# EasyEDA Pro project ProPrj_Starcat_FOC双路矢量控制器_2024-11-11.epro, board 双路大功率矢量控制器_2 (continued)
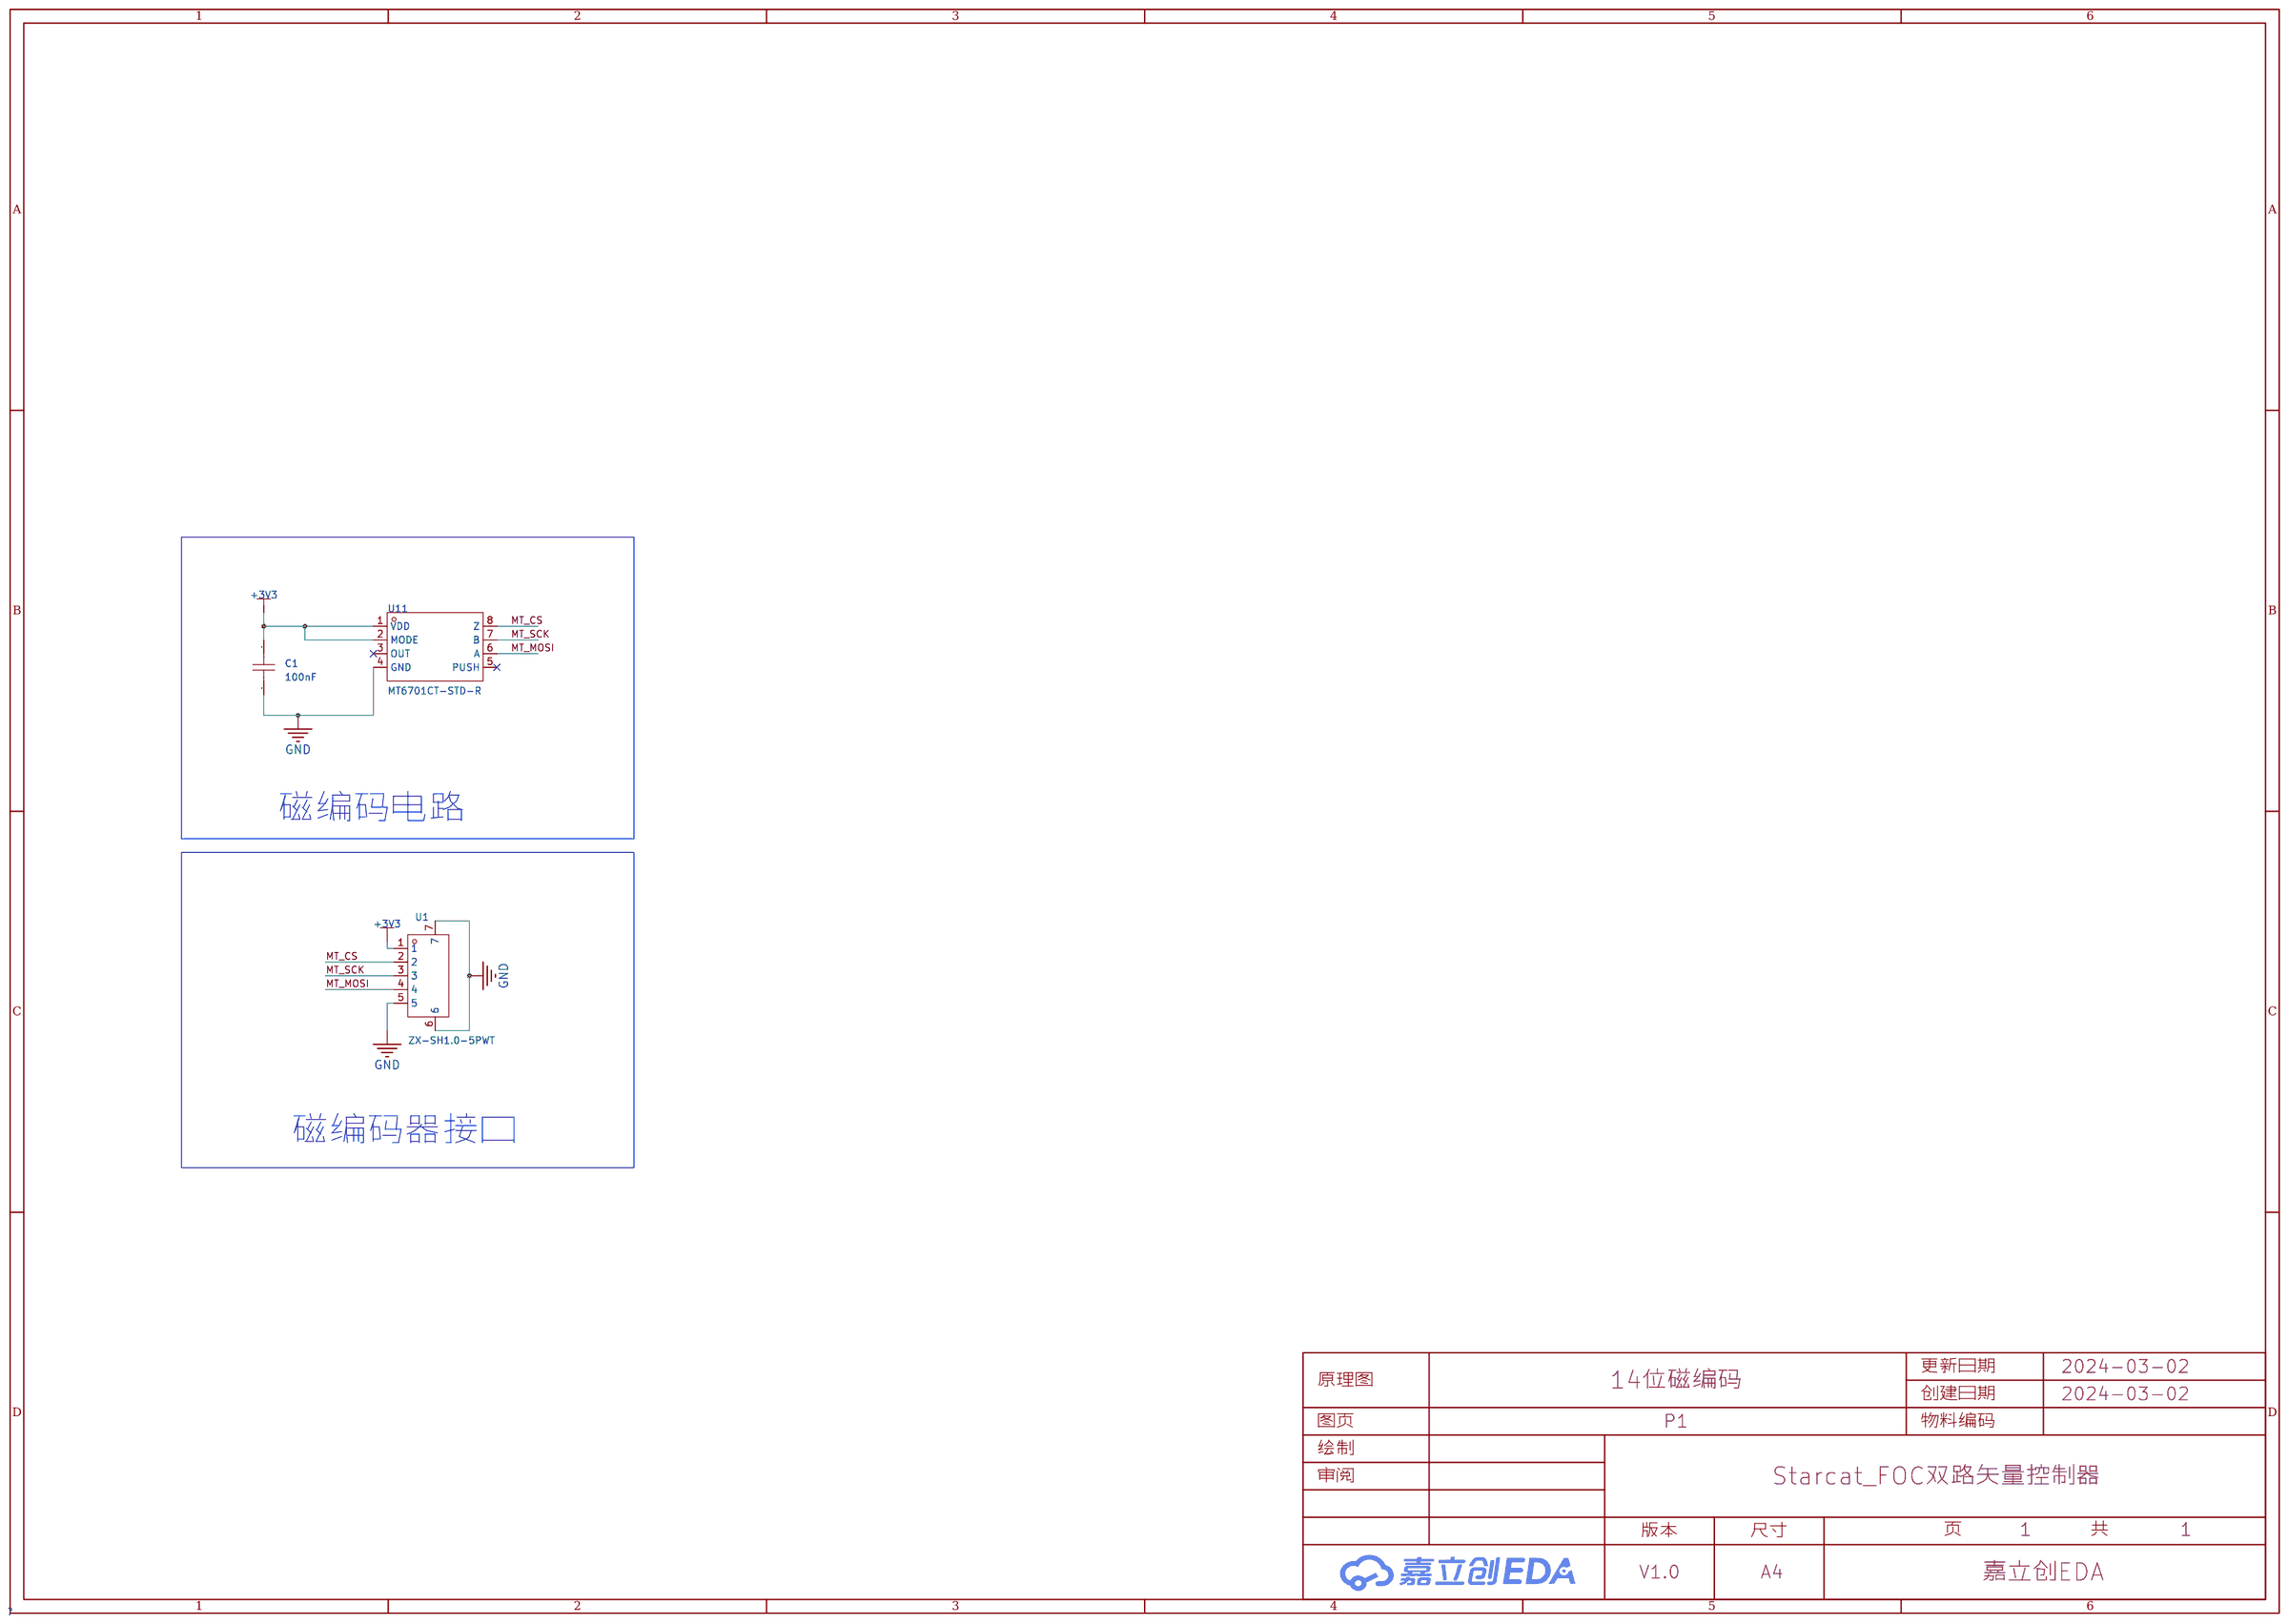
[diagram p0: schematic sheet]
## Routing (per net, layer and track width the routed paths; a pad name or vN(x,y) marks a point on that pad's centre or on a via; arc(x,y) is an arc through that point) (continued)
  Bottom Layer w0.635: 61.95,28.7 63.12,28.7
  vias: v1(10.22,1.47) v1(10.75,48.1) v1(69.13,41.16)
+3V3_VDA: length 6.1
  Top Layer w0.305: 29.28,33.37 30.54,33.37 C5.1 31.78,34.6 31.78,36.07 31.88,36.17 33.34,36.17 33.36,36.15
+3V3A: length 122.2
  Top Layer w0.305: v1(11.68,39.86) 12.83,39.86 13.11,40.14 U18.24 ; v1(54.93,25.82) 54.91,25.8 54.19,25.8 49.2,20.82 ; 34.28,20.81 29.32,25.77 29.3,25.77 ; v1(30.94,29.18) 30.94,29.33 28.92,31.35 26.61,31.35 26.35,31.61 v1(26.35,33.15) 26.35,33.23 26.48,33.37 C3.1 ; U17.24 55.47,40.08 v1(53.34,37.95)
  Top Layer w0.508: 27.86,33.34 27.9,33.38 27.83,33.45 26.65,33.45 26.63,33.47 ; v1(53.34,37.95) 53.26,38.03 v1(48.63,38.03)
  Inner2 w0.305: v1(53.34,37.95) 54.38,36.91 v1(56.55,36.91)
  Inner2 w0.508: 26.35,33.17 26.35,33.12 26.38,33.09 41.27,33.09 43.83,35.65 46.57,35.65 48.63,37.71 v1(48.63,38.03)
  Bottom Layer w0.305: v1(29.19,25.81) 29.19,27.43 v1(30.94,29.18) ; v1(56.55,36.91) 57.04,36.42 57.04,30.08 54.93,27.97 v1(54.93,25.82) ; v1(53.34,37.95) 53.21,37.82
  Bottom Layer w0.508: v1(11.68,39.86) 12.45,40.62 22.86,40.62 23.62,39.86 23.62,33.89 24.36,33.15 v1(26.35,33.15) 26.35,35.85 30.27,39.77 TP3.1 ; v1(53.34,37.95) 53.34,40.75 51.25,42.84 U2.5 50.07,44.91 49.78,45.19 49.78,46.62 C8.2
+5V:
  vias: v1(37.59,1.76)
+9V: length 20
  Bottom Layer w0.305: 70.06,43.2 70.03,43.2 70.02,43.19
  Bottom Layer w0.381: U12.2 73.53,39.16 74.22,39.85 74.22,42.86 73.88,43.2 70.06,43.2
  Bottom Layer w0.508: 68.9,46.54 69.66,46.54 69.92,46.28 69.92,44.57 70.32,44.18 70.96,44.18 71.01,44.23 ; 70.06,44.14 70.06,43.2
AGND: length 537.6
  Top Layer w0.305: 49.77,48.23 49.62,48.08 49.62,43.45 49.91,43.16 52.2,43.16 ; U16.63 35.86,45.48 35.56,45.79 33.5,45.79 C13.2 ; R25.1 43.51,26.71 C45.1 v1(41.6,26.71) C98.1 ; 25.58,35.49 25.15,35.92 24.38,35.92 24.11,35.64 U18.55 ; 25.58,35.49 25.58,36.62 v1(25.57,36.63) ; 25.58,35.49 26.24,34.83 C3.2 27.83,34.83 L4.1 ; 13.43,45.68 13.02,45.27 10.42,45.27 10,45.69 ; C82.1 52.01,45.89 51.69,45.57 51.69,43.67 52.2,43.16 ; 30.63,36.21 30.05,35.63 28.48,35.63 27.94,35.09 ; 52.2,43.16 53.21,43.16 53.47,42.9 53.47,41.59 U17.28 ; U16.18 35.86,30.76 33.93,28.82 33.93,27.41 34.63,26.71 v1(35.9,26.71) 37.16,26.71 R26.1 ; v1(7.37,26.27) 7.81,26.71 C88.2 ; v1(24.53,35.94) 23.59,36.88 v1(19.82,36.88)
  Top Layer w0.508: 70.06,1.7 71,1.7 71.03,1.74 ; 70.06,1.7 70.06,2.14 ; 70.06,1.7 70.06,2.14 ; 70.06,1.7 70.06,0.95 69.72,0.61 67.24,0.61 v1(67.2,0.66) 66.01,0.66 U13.7 ; 70.06,2.14 70.06,4.84 ; 71.88,45.84 72.65,45.84 72.74,45.93 ; 13.69,45.73 13.73,45.77 13.73,46.97 ; 69.19,45.89 68.37,45.89 68.11,46.15 68.11,46.66 67.67,47.1 66.16,47.1 65.81,46.75 65.81,46 ; 19.69,45.93 19.93,46.16 19.93,47.39 ; 47.79,45.78 47.79,47.64 48.37,48.23 49.77,48.23 v1(49.79,48.25) ; 74.34,20 72.79,20 v1(72.77,20.02) ; U10.5 14.83,5.08 15.24,4.68 15.24,2.58 U10.6 ; 73.37,27.18 74.06,27.88 74.06,31.02 73.32,31.76 70.94,31.76 ; 73.06,46 73.56,46 74.17,45.4 74.17,42.82 73.66,42.31 73.1,42.31 ; 30.57,42.76 30.63,42.82 30.63,45.23 30.14,45.72 22.66,45.72 ; 9.88,45.8 9.79,45.89 9.79,46.94 ; C82.1 52.32,46.15 C84.1 ; 72.95,41.32 73,41.37 74.23,41.37 74.65,40.95 74.65,39.39 ; 8.87,47.11 8.87,45.99 8.86,45.98 ; 56.12,47.1 56.16,47.07 56.16,45.93 ; 72.79,26.68 70.66,26.68 ; 72.79,26.68 72.79,22.55 ; 72.79,26.68 73.09,26.68 73.22,26.81 ; 9.96,47.11 9.95,47.12 8.79,47.12 ; 56.32,47.3 57.54,47.3 57.88,46.96 60.86,46.96 61.26,46.55 61.26,46.28 ; C11.2 C14.1 44.7,45.7 44.7,47.22 45.34,47.86 47.12,47.86 47.75,47.22 C17.1 ; 8.23,0.73 14.26,0.73 ; v1(58.08,48.35) 63.76,48.35 64.39,47.73 v1(64.39,46.76) 64.5,46.76 65.48,45.78
  Top Layer w0.635: 7.94,34.78 9.15,34.78 v1(9.16,34.77) ; v1(72.89,41.34) 72.55,41.34 C65.1 ; v1(7.24,48.11) 8.51,48.11 8.83,47.79 8.83,47.12 8.87,47.09 ; 10.91,41.25 10.32,41.25 v1(10.31,41.24) 10.27,41.2 7.99,41.2
  Top Layer w0.762: 45.8,32.41 45.78,32.39 44.64,32.39 ; 47.53,26.65 47.53,26.48 46.97,25.92 43.93,25.92 43.45,26.4
  Inner1 w0.305: v1(34.82,45.76) 34.79,45.79 31.04,45.79 30.61,45.36 v1(30.61,42.65) 25.97,42.65 25.6,42.28 25.6,36.23 26.1,35.73 30.1,35.73 v1(30.6,36.23)
  Inner1 w0.508: v1(76.3,29.31) 76.25,29.31 72.77,25.83 v1(72.77,22.51) ; v1(30.61,42.65) 28.84,40.88 16.1,40.88 14.56,42.42 13.84,42.42 13.75,42.51 13.75,47.87 14.29,48.41 19.69,48.41 19.92,48.18 v1(19.92,47.42) ; v1(49.79,48.25) 49.89,48.35 v1(58.08,48.35) 62.75,48.35 63.25,47.86 v1(63.25,46.84)
  Inner1 w0.635: v1(2.21,24.91) 2.15,24.97 v1(1.42,24.97) 1.2,25.2 v1(1.2,35.27) ; 9.69,41.24 9.54,41.24 8.83,41.95 v1(8.83,47.23) ; 9.69,41.24 6.95,38.5 v1(3.43,38.5) ; 9.69,41.24 v1(10.31,41.24) 10.42,41.13 13.71,41.13 15.75,39.09 v1(15.88,39.09) ; v1(64.39,46.76) 64.5,46.87 72.11,46.87 v1(73,45.98) ; v1(9.16,34.77) 9.16,32.59 9.01,32.44 1.8,32.44 1.48,32.13
  Inner2 w0.508: v1(12.11,0.62) 40.01,0.62 v1(40.13,0.74) 40.22,0.66 v1(67.2,0.66) 70.8,0.66 71.25,1.1 71.25,16.23 70.99,16.49
  Inner2 w0.635: v1(74.34,8.48) 72.63,10.19 72.63,15.33 v1(72.59,15.37)
  Bottom Layer w0.305: LED3.2 2.03,25.25 ; v1(7.37,26.27) 7.37,25.25 ; 65.5,27.15 65.39,27.26 62.07,27.26 ; 18.5,46.69 17.77,46.69 17.06,45.98 15.91,45.98 15.4,45.47 15.4,44.66 15.59,44.47 16.24,44.47 16.61,44.11 16.61,41.44 16.44,41.27 10.34,41.27 v1(10.31,41.24) ; 64.35,27.1 64.35,24.97 64.34,24.96 ; 76.3,29.37 v1(76.3,29.31) 76.3,29.16 76.18,29.05 73.85,29.05 73.85,28.68 72.35,27.18 69.07,27.18 ; 41.66,25.25 41.66,26.65 v1(41.6,26.71) ; v1(35.9,26.71) 35.94,26.66 35.94,25.25
  Bottom Layer w0.381: U12.12 73.37,32.16 73.85,31.68 73.85,29.05 ; U12.7 76.2,35.66 76.34,35.79 ; U12.5 74.05,37.06 74.42,36.68 76.31,36.68 76.34,36.65
  Bottom Layer w0.508: 64.45,46.69 64.37,46.77 62.16,46.77 ; v1(52.32,46.08) 52.32,47.38 U2.2 ; v1(7.24,48.11) 7.24,47.91 6.04,46.72 5.64,46.72 ; v1(25.57,36.63) 25.79,36.84 TP1.1 ; 37.64,48.34 37.67,48.31 37.67,47.74 37.32,47.39 35.66,47.39 34.82,46.55 v1(34.82,45.76) 34.82,43.78 ; v1(58.08,48.35) 57.42,48.35 57.24,48.17 54.99,48.17 ; v1(47.53,26.69) 48.99,28.15 50.42,28.15 50.93,28.66 50.93,29.89 50.35,30.46 48.04,30.46 46.04,32.46 44.77,32.46 v1(44.64,32.59) ; 59.78,47.3 59.78,46.47 60.02,46.22 61.47,46.22 62.08,46.82 ; 71.17,46.66 72.32,46.66 v1(73,45.98) 73.5,45.98 75.1,44.39 ; 68.73,44.06 68.56,43.89 68.56,42.42 69.02,41.95 71.47,41.95 72.08,41.34 v1(72.89,41.34) ; v1(61.41,37.05) 61.41,30.26 59,27.85 59,27.2 59.51,26.7 60.17,26.7 60.67,26.19 61.73,26.19 61.96,26.43 61.96,27.17 ; v1(63.25,46.84) 63.25,46.8 C2.1
  Bottom Layer w0.635: 1.96,38.42 2.02,38.48 5.14,38.48 ; SW2.2 73.03,15.37 v1(72.59,15.37) 72.5,15.28 L1.1 ; 76.27,29.34 76.3,29.37 76.34,29.41 76.34,43.06 75.19,44.2 ; 74.94,22.81 73.07,22.81 v1(72.77,22.51) 72.77,19.98 72.65,19.86 ; 1.89,40.26 1.89,35.47 ; 72.65,19.86 70.49,19.86 ; 72.65,19.86 74.13,19.86
  vias: v1(2,35.3) v1(15.9,38.32) v1(15.9,37.62) v1(15.9,36.88) v1(16.66,39.09) v1(16.68,38.32) v1(16.68,37.62) v1(16.68,36.88) v1(17.44,39.09) v1(17.47,38.32) v1(17.47,37.62) v1(17.47,36.88) v1(18.23,39.09) v1(18.25,38.32) v1(18.25,37.62) v1(18.25,36.88) v1(19.01,39.09) v1(19.03,38.32) v1(19.03,37.62) v1(19.03,36.88) v1(19.79,39.09) v1(19.82,38.32) v1(19.82,37.62) v1(25.26,35.84) v1(37.63,48.36) v1(40.13,1.88) v1(58.3,38.97) v1(58.28,38.32) v1(58.28,37.68) v1(58.28,37.05) v1(59.08,38.97) v1(59.06,38.32) v1(59.06,37.68) v1(59.06,37.05) v1(59.84,38.32) v1(59.84,37.68) v1(59.84,37.05) v1(59.86,38.97) v1(60.65,38.97) v1(60.63,38.32) v1(60.63,37.68) v1(60.63,37.05) v1(61.3,46.12) v1(61.43,38.97) v1(61.41,38.32) v1(61.41,37.68) v1(62.21,38.97) v1(62.19,38.32) v1(62.19,37.68) v1(62.19,37.05) v1(68.02,0.64) v1(70.05,1.7) v1(70.99,16.49) v1(72.19,41.33) v1(74.34,14.15) v1(74.66,39.17)
GND_VDA: length 5.6
  Top Layer w0.305: 33.36,36.65 31.72,36.65 31.37,36.3 31.37,35.16 31.04,34.83 C5.2 30.6,34.83 L4.2
PGND: length 96.1
  Top Layer w0.381: 54.74,35.79 60.71,35.79 60.97,35.53 U17.44 ; 54.74,35.79 54.1,35.79 53.97,35.67 53.97,34.17 U17.30 ; 54.74,35.79 54.97,35.56 U17.32 ; 12.95,35.92 11.94,35.92 11.61,35.59 U18.30 11.6,34.28 11.6,30.37 v1(10.8,29.57) ; 12.95,35.92 18.16,35.92 18.61,35.47 U18.44 ; 12.95,35.92 12.61,35.57 U18.32
  Top Layer w0.508: 52.45,26.72 52.45,26.06 v1(52.26,25.86)
  Inner1 w0.508: v1(49.17,26.7) 50.09,25.78 52.18,25.78 v1(52.26,25.86)
  Inner2 w0.305: v1(10.92,26.65) 10.92,29.44 v1(10.8,29.57)
  Inner2 w0.508: v1(14.22,26.64) 14.13,26.64 11.23,23.74 11.23,22.08 10.7,21.55 10.7,13.3 v1(10.76,13.3) ; v1(49.17,26.7) 46.98,24.52 43.08,24.52 40.82,22.25 v1(40.82,12.7) ; v1(10.92,26.65) 10.67,26.4 10.67,22.41 10.17,21.91 v1(10.17,12.71)
  Bottom Layer w0.305: v1(10.92,26.65) 10.89,26.62 10.86,26.62
  Bottom Layer w0.508: v1(52.26,25.86) 52.55,26.15 52.55,29.44 55.49,32.38 v1(55.49,35.84)
  vias: v1(7.2,10.97) v1(29.32,13.97) v1(29.36,12.88) v1(29.42,11.61) v1(29.63,12.29) v1(29.68,13.43) v1(29.76,11.01) v1(29.98,13.98) v1(30.05,12.88) v1(30.09,11.62) v1(30.32,13.44) v1(30.26,12.3) v1(30.45,10.97) v1(30.61,13.98) v1(30.71,12.86) v1(30.74,11.59) v1(30.89,12.24) v1(30.96,13.44) v1(31.16,11) v1(31.26,14) v1(31.33,12.85) v1(31.42,11.58) v1(31.54,12.23) v1(31.57,13.46) v1(40.82,11.88) v1(56.33,35.86) v1(60.48,13.97) v1(60.52,12.88) v1(60.57,11.6) v1(60.83,13.43) v1(60.79,12.28) v1(60.91,11.01) v1(61.14,13.98) v1(61.21,12.88) v1(61.24,11.62) v1(61.42,12.29) v1(61.48,13.44) v1(61.6,10.97) v1(61.77,13.98) v1(61.86,12.86) v1(61.9,11.59) v1(62.05,12.24) v1(62.12,13.44) v1(62.32,11) v1(62.41,13.99) v1(62.48,12.84) v1(62.58,11.58) v1(62.73,13.45) v1(62.69,12.22)
VBUS_5V: length 22.7
  Top Layer w0.635: 7.83,40.42 10.23,40.42 v1(10.8,39.86) ; v1(10.8,35.92) 10.49,35.61 7.86,35.61
  Bottom Layer w0.635: v1(10.8,39.86) v1(10.8,35.92) 10.8,32.74 10.32,32.26 6.09,32.26 5.1,31.28 5.1,30.64 ; 4.89,30.81 3.45,30.81 2.78,31.48
AH_1: length 18.2
  Top Layer w0.305: v1(58.8,43.28) 58.97,43.11 U17.17 ; v1(52.45,38.97) 52.14,38.65 U16.41
  Inner1 w0.305: v1(52.45,38.97) 55.44,38.97 58.8,42.33 v1(58.8,43.28)
AH_2: length 36.7
  Top Layer w0.305: U16.37 40.25,36.65 v1(39.91,36.99) ; v1(16.05,45.13) 16.05,44.81 16.61,44.25 U18.17
  Inner2 w0.305: v1(39.91,36.99) 39.91,37.03 32.42,44.53 18.53,44.53 17.24,45.82 16.55,45.82 16.05,45.31 v1(16.05,45.13)
AL_1: length 17.1
  Top Layer w0.305: U17.18 58.47,40.16 58.17,39.86 57.02,39.86 53.72,36.55 52.07,36.55 50.67,35.15 U16.34
AL_2: length 40.6
  Top Layer w0.305: U18.18 16.11,43.6 v1(15.99,43.71) ; U16.23 38.36,34.39 v1(38.35,34.39)
  Inner2 w0.305: v1(15.99,43.71) 15.99,40.99 15.49,40.49 13.33,40.49 12.83,39.98 12.83,35.54 14.08,34.28 38.24,34.28 v1(38.35,34.39)
AO_1: length 20.9
  Top Layer w0.305: U17.46 61.97,31.73 64.13,29.57 65.58,29.57 66.42,28.73 66.42,27.85 66.76,27.51 68.14,27.51 68.81,26.84 68.81,26.72
  Top Layer w0.508: C66.2 68.97,17.76
AO_2: length 28.7
  Top Layer w0.305: v1(26.92,29.44) 26.42,29.95 24.02,29.95 22.25,31.73 19.94,31.73 19.61,32.06 U18.46
  Top Layer w0.508: v1(30.73,26.78) 31.03,26.78 38.1,19.7 38.1,17.76
  Inner2 w0.305: v1(26.92,29.44) 29.6,29.44 30.73,28.31 v1(30.73,26.78)
BH_1: length 16.9
  Top Layer w0.305: U16.42 51.62,39.15 v1(52.2,39.73) ; U17.19 57.97,43.09 v1(58.04,43.16)
  Inner1 w0.305: v1(58.04,43.16) 58.04,42.35 55.42,39.73 v1(52.2,39.73)
BH_2: length 37.6
  Top Layer w0.305: U18.19 15.61,43.08 v1(15.3,43.39) ; v1(40.64,37.32) 40.64,37.18 40.68,37.15 U16.38
  Inner2 w0.305: v1(15.3,43.39) 15.26,43.43 15.26,45.21 16.44,46.39 17.59,46.39 19.02,44.96 32.8,44.96 40.44,37.32 v1(40.64,37.32)
BL_1: length 15.7
  Top Layer w0.305: U16.35 50.53,35.65 51.94,37.06 53.47,37.06 56.77,40.36 57.27,40.36 57.47,40.57 U17.20
BL_2: length 40.9
  Top Layer w0.305: v1(14.57,43.16) 15.11,42.62 U18.20 ; v1(39.5,34.22) 39.86,33.86 U16.26
  Inner2 w0.305: v1(39.5,34.22) 39.06,33.78 13.69,33.78 12.32,35.16 12.32,40.36 13.08,41.13 14.1,41.13 14.57,41.6 v1(14.57,43.16)
BO_1: length 20.1
  Top Layer w0.305: U17.41 59.47,30.93 61.55,28.85 61.55,27.68 61.76,27.47 63.09,27.47 63.74,26.83
  Top Layer w0.508: C69.2 64.02,23.35 60.07,19.41 60.07,18.14
BO_2: length 24
  Top Layer w0.305: U18.41 17.11,31.89 19.13,29.87 21.41,29.87 v1(22.1,29.19)
  Top Layer w0.508: 28.96,17.25 28.96,19.79 25.78,22.97 v1(25.78,26.78)
  Inner2 w0.305: v1(25.78,26.78) 24.51,26.78 v1(22.1,29.19)
CAN_H: length 37.3
  Top Layer w0.305: v1(14.86,47.35) 15.12,47.08 15.12,47.03
  Inner1 w0.305: 27.02,43.44 27.01,43.45 27.01,44.69 26.72,44.98 17.92,44.98 17,45.9 16.3,45.9 v1(14.86,47.35)
  Bottom Layer w0.305: v1(14.86,47.35) 14.22,46.71 U19.7 ; 45.59,43.61 45.59,42.91 45.29,42.6 42.5,42.6 41.61,41.71 34.46,41.71 32.41,43.76 27.06,43.76
  vias: v1(27.02,43.39)
CAN_L: length 39.5
  Top Layer w0.305: v1(14.61,44.68) 14.61,45.37 14.83,45.6
  Inner1 w0.305: 26.05,43.4 26.05,43.49 26.05,43.5 26.05,43.91 25.64,44.32 14.97,44.32 v1(14.61,44.68)
  Bottom Layer w0.305: v1(14.61,44.68) 14.68,44.76 14.68,45.11 14.39,45.41 13.4,45.41 ; 26.13,43.8 26.13,43.06 26.46,42.73 27.42,42.73 27.97,43.28 32.23,43.28 34.21,41.31 41.85,41.31 42.64,42.1 46.24,42.1 46.6,42.46 46.6,43.83 46.71,43.93
  vias: v1(26.05,43.42)
CAN_RX: length 23.9
  Top Layer w0.305: 36.88,44.35 36.88,46.14 35.97,47.04 32.88,47.04 32.44,47.49
  Inner1 w0.305: 23.82,47.46 24.52,48.16 31.83,48.16 v1(32.52,47.46)
  Bottom Layer w0.305: 18.86,44.08 22.75,44.08 23.83,45.16 23.83,47.52
  vias: v1(23.84,47.47)
CAN_TX: length 21.1
  Top Layer w0.305: v1(31.51,47.48) 32.41,46.57 35.61,46.57 36.35,45.82 36.35,44.26
  Inner1 w0.305: v1(31.51,47.48) 25.18,47.48 24.15,46.45 19.72,46.45 19.3,46.86 19.3,47.48
  Bottom Layer w0.305: 18.67,47.85 18.8,47.85 v1(19.13,47.52)
CH_1: length 16.1
  Top Layer w0.305: v1(51.82,40.49) 50.98,39.65 U16.43 ; U17.21 56.97,42.85 v1(57.28,43.16)
  Inner1 w0.305: v1(57.28,43.16) 57.28,42.29 55.48,40.49 v1(51.82,40.49)
CH_2: length 45.3
  Top Layer w0.305: v1(42.67,37.82) 42.83,37.82 43,37.65 U16.39 ; v1(14.35,39.35) 14.61,39.6 U18.21
  Bottom Layer w0.305: v1(42.67,37.82) 41.15,36.3 39.24,36.3 36.83,33.89 34.29,33.89 33.53,33.12 33.53,31.91 32.12,30.5 14.94,30.5 14.35,31.09 v1(14.35,39.35)
CL_1: length 20.2
  Top Layer w0.305: v1(50.93,36.94) 50.15,36.15 U16.36 ; U17.22 56.47,43.5 v1(56.64,43.67)
  Inner1 w0.305: v1(56.64,43.67) 56.64,42.3 55.6,41.25 51.31,41.25 50.93,40.87 v1(50.93,36.94)
CL_2: length 36
  Top Layer w0.305: U18.22 14.11,39.99 v1(13.46,39.35) ; U16.27 40.36,33.99 v1(40.64,34.26)
  Inner2 w0.305: v1(13.46,39.35) 13.46,35.67 14.44,34.69 37.64,34.69 37.95,35 39.75,35 40.49,34.26 v1(40.64,34.26)
CO_1: length 22.1
  Top Layer w0.305: 59.06,26.71 58.26,27.51 56.64,27.51 56.51,27.64 56.51,28.8 57.02,29.3 57.02,34.11 U17.36
  Top Layer w0.508: 58.98,26.7 59.01,26.67 v1(59.01,25.84) 57.79,25.84 51.56,19.61 51.56,18.14
CO_2: length 19.6
  Top Layer w0.305: U18.36 14.61,30.46 15.88,29.19 v1(16,29.19)
  Top Layer w0.508: v1(19.19,26.82) 19.19,21.3 20.7,19.79 20.7,17.89
  Inner2 w0.305: v1(16,29.19) 18.29,26.9 19.3,26.9
CS_ENC_A_1: length 67
  Top Layer w0.305: U16.56 39.36,42.64 40.17,41.84 41.67,41.84 v1(42.75,40.77) ; U13.2 v1(67.05,3.15)
  Inner2 w0.305: v1(48.67,31.94) 48.84,31.94 49.82,30.97 67.51,30.97 68.5,29.98 68.5,10.47 67.05,9.02 v1(67.05,3.15)
  Bottom Layer w0.305: v1(48.67,31.94) 48.67,34.84 v1(42.75,40.77) ; R15.1 67.03,3.15 v1(67.05,3.15)
CS_ENC_A_2: length 87.1
  Top Layer w0.305: v1(41.05,40.28) 40.39,40.93 39.86,40.93 38.36,42.43 U16.58 ; U10.2 10.24,3.15
  Inner2 w0.305: v1(41.05,40.28) 41.06,40.28 43.75,42.97 48.07,42.97 49.78,41.25 49.78,36.68 38.35,25.25 38.35,10.01 37.21,8.87 12.19,8.87 10.22,6.9 v1(10.22,3.02)
D+: length 7.9
  Top Layer w0.305: v1(5.59,44.17) 5.59,38.68 6.02,38.25 USB1.A6
D-: length 12.2
  Top Layer w0.305: 7.57,37.77 5.7,37.77 4.95,38.52 4.95,44.43 v1(6.48,45.95)
  Bottom Layer w0.305: 5.45,45.45 5.97,45.45 v1(6.48,45.95)
DCBUS: length 42.1
  Top Layer w0.305: U17.53 65.47,32.49 ; U17.54 65.97,32.49
  Top Layer w0.508: 53.37,34.81 53.37,32.16 50.18,28.97 48.51,28.97 47.85,28.31 47.72,28.31
  Top Layer w0.762: v1(45.59,28.15) 45.64,28.11 C85.1 ; 70.61,29.57 68.33,29.57 65.74,32.16 65.74,34.65 ; 70.61,29.57 71.37,29.57 70.62,28.81 ; 70.61,29.57 70.62,29.56 70.62,28.81 ; v1(8.89,30.19) v1(9.65,30.19) v1(9.65,30.82) 9.32,30.82 ; 70.62,28.81 C62.1 71.69,29.17 C63.2 ; 70.62,28.81 v1(70.61,28.81) ; v1(8.89,30.82) 9.32,30.82 ; 9.32,30.82 10.92,32.42 10.92,34.78 ; 9.33,28.16 9.3,28.19 9.3,30.16 ; v1(45.59,27.52) v1(46.35,27.52)
  Inner1 w0.508: 38.48,23.6 v1(38.48,26.65)
  vias: v1(7.17,14.95) v1(8.89,23.47) v1(8.89,22.84) v1(9.65,23.47) v1(9.65,22.84) v1(13.44,17.98) v1(13.54,16.68) v1(13.46,15.37) v1(13.62,19.24) v1(13.81,17.39) v1(13.95,18.68) v1(14.02,16.01) v1(14.19,18.03) v1(14.19,15.35) v1(14.27,19.26) v1(14.25,16.69) v1(14.61,18.68) v1(14.59,17.35) v1(14.73,16.01) v1(14.92,19.26) v1(14.91,18.04) v1(14.99,16.66) v1(14.98,15.33) v1(15.27,18.68) v1(15.31,17.38) v1(15.48,15.94) v1(15.57,19.26) v1(15.59,18.03) v1(15.78,16.64) v1(15.83,15.31) v1(15.92,18.68) v1(15.99,17.35) v1(16.22,19.26) v1(16.22,15.93) v1(16.27,18.01) v1(16.53,16.64) v1(16.59,18.64) v1(16.58,15.34) v1(16.76,17.35) v1(16.88,19.25) v1(16.9,15.91) v1(16.95,18.06) v1(22.22,17.92) v1(22.25,15.31) v1(22.32,16.63) v1(22.4,19.19) v1(22.59,17.33) v1(22.74,18.62) v1(22.8,15.95) v1(22.97,17.97) v1(23.04,16.64) v1(22.97,15.29) v1(23.05,19.2) v1(23.4,18.62) v1(23.37,17.3) v1(23.52,15.95) v1(23.7,19.2) v1(23.7,17.98) v1(23.77,16.61) v1(23.76,15.27) v1(24.06,18.62) v1(24.1,17.32) v1(24.26,15.88) v1(24.35,19.2) v1(24.37,17.97) v1(24.56,16.58) v1(24.62,15.25) v1(24.7,18.62) v1(24.77,17.29) v1(25,19.2) v1(25.01,15.87) v1(25.06,17.95) v1(25.32,16.58) v1(25.38,18.59) v1(25.37,15.28) v1(25.54,17.3) v1(25.66,19.19) v1(25.74,18) v1(25.69,15.85) v1(31.06,17.95) v1(31.08,15.34) v1(31.24,19.22) v1(31.16,16.66) v1(31.43,17.36) v1(31.57,18.66) v1(31.64,15.98) v1(31.81,18) v1(31.81,15.33) v1(31.89,19.23) v1(31.87,16.67) v1(32.23,18.65) v1(32.21,17.33) v1(32.35,15.98) v1(32.54,19.23) v1(32.53,18.01) v1(32.61,16.64) v1(32.6,15.3) v1(32.89,18.66) v1(32.93,17.35) v1(33.1,15.91) v1(33.19,19.23) v1(33.21,18) v1(33.4,16.61) v1(33.54,18.66) v1(33.45,15.29) v1(33.61,17.32) v1(33.84,19.23) v1(33.84,15.9) v1(33.89,17.98) v1(34.21,18.62) v1(34.15,16.61) v1(34.2,15.31) v1(34.38,17.33) v1(34.5,19.22) v1(34.52,15.88) v1(34.57,18.03) v1(44.67,18) v1(44.7,15.39) v1(44.78,16.71) v1(44.86,19.27) v1(45.05,17.42) v1(45.19,18.71) v1(45.25,16.03) v1(45.43,18.05) v1(45.42,15.38) v1(45.51,19.28) v1(45.49,16.72) v1(45.62,23.7) v1(45.62,23.06) v1(45.85,18.7) v1(45.82,17.38) v1(45.97,16.03) v1(46.16,19.28) v1(46.15,18.06) v1(46.22,16.69) v1(46.21,15.35) v1(46.25,23.7) v1(46.28,23) v1(46.35,28.15) v1(46.51,18.71) v1(46.55,17.4) v1(46.71,15.96) v1(46.81,19.28) v1(46.83,18.06) v1(47.01,16.66) v1(47.07,15.34) v1(47.15,18.71) v1(47.23,17.38) v1(47.46,19.28) v1(47.51,18.04) v1(47.46,15.96) v1(47.83,18.67) v1(47.77,16.66) v1(47.82,15.36) v1(47.99,17.38) v1(48.11,19.27) v1(48.14,15.93) v1(48.19,18.08) v1(53.59,18.04) v1(53.61,15.43) v1(53.69,16.75) v1(53.77,19.31) v1(53.96,17.46) v1(54.11,18.75) v1(54.17,16.07) v1(54.34,18.09) v1(54.34,15.42) v1(54.42,19.32) v1(54.4,16.76) v1(54.74,17.42) v1(54.76,18.74) v1(54.89,16.07) v1(55.07,19.32) v1(55.06,18.1) v1(55.14,16.73) v1(55.13,15.39) v1(55.42,18.75) v1(55.47,17.44) v1(55.63,16) v1(55.72,19.32) v1(55.74,18.1) v1(55.93,16.7) v1(55.99,15.38) v1(56.07,18.75) v1(56.14,17.42) v1(56.37,19.32) v1(56.42,18.08) v1(56.38,16) v1(56.75,18.71) v1(56.68,16.7) v1(56.74,15.4) v1(56.91,17.42) v1(57.03,19.31) v1(57.1,18.12) v1(57.06,15.97) v1(62.21,18) v1(62.24,15.39) v1(62.32,16.71) v1(62.4,19.27) v1(62.59,17.42) v1(62.73,18.71) v1(62.79,16.03) v1(63.05,19.28) v1(62.97,18.05) v1(63.03,16.72) v1(62.97,15.38) v1(63.39,18.7) v1(63.36,17.38) v1(63.51,16.03) v1(63.7,19.28) v1(63.69,18.06) v1(63.76,16.69) v1(63.75,15.35) v1(64.05,18.71) v1(64.09,17.4) v1(64.35,19.28) v1(64.25,15.96) v1(64.37,18.06) v1(64.55,16.66) v1(64.61,15.34) v1(64.69,18.71) v1(64.77,17.38) v1(65,19.28) v1(65.05,18.04) v1(65,15.96) v1(65.31,16.66) v1(65.37,18.67) v1(65.36,15.36) v1(65.53,17.38) v1(65.65,19.27) v1(65.73,18.08) v1(65.68,15.93) v1(71.37,28.81)
EN_GATE: length 64.9
  Top Layer w0.305: v1(39.02,36.97) 39.02,36.91 39.74,36.18 41.7,36.18 43.22,34.65 U16.33 51.05,34.65 v1(52.33,35.94) ; v1(57.55,43.88) 57.63,43.96 59.26,43.96 59.47,43.75 U17.16 ; v1(16.83,45.19) 17.11,44.91 U18.16
  Inner1 w0.305: v1(57.55,43.88) 57.11,44.33 56.21,44.33 55.88,44 55.88,42.27 55.27,41.66 51.01,41.66 50.28,40.94 50.28,36.59 50.94,35.94 v1(52.33,35.94)
  Inner2 w0.305: v1(16.83,45.19) 17.97,44.05 32.08,44.05 39.02,37.12 v1(39.02,36.97)
GH_A_1: length 8.8
  Top Layer w0.305: U17.47 62.47,32.12 64.62,29.98 65.99,29.98 67.32,28.65 R44.1
GH_A_2: length 12.9
  Top Layer w0.305: U18.47 20.11,32.32 20.29,32.13 22.41,32.13 24.19,30.36 27.28,30.36 29.1,28.54 29.1,28.22
GH_B_1: length 6.7
  Top Layer w0.305: 62.23,28.42 62.23,28.85 59.97,31.11 U17.42
GH_B_2: length 10.4
  Top Layer w0.305: R42.1 23.93,28.22 21.87,30.28 19.35,30.28 17.61,32.03 U18.42
GH_C_1: length 6
  Top Layer w0.305: U17.37 57.47,28.28 R46.1
GH_C_2: length 7.1
  Top Layer w0.305: R43.1 17.54,28.65 15.11,31.08 U18.37
GL_A_1: length 8.4
  Top Layer w0.305: R52.1 65.51,28.06 64.52,29.06 63.75,29.06 61.47,31.34 U17.45
GL_A_2: length 12.3
  Top Layer w0.305: R47.1 27.13,28.22 25.88,29.47 23.93,29.47 22.18,31.22 19.69,31.22 19.11,31.8 U18.45
GL_B_1: length 6.7
  Top Layer w0.305: U17.40 58.97,30.39 60.71,28.65 60.71,28.22
GL_B_2: length 10
  Top Layer w0.305: U18.40 16.61,31.63 18.77,29.47 20.93,29.47 22.18,28.22 R48.1
GL_C_1: length 6.2
  Top Layer w0.305: R51.1 55.76,28.81 56.47,29.53 U17.35
GL_C_2: length 6.8
  Top Layer w0.305: U18.35 14.11,30.07 15.89,28.28 R49.1
LED1: length 3.5
  Top Layer w0.305: 42.83,47.48 42.36,47.01 U16.50
MOSI_ENC_Z_1: length 59.4
  Top Layer w0.305: U13.4 v1(69.05,3.15) ; U16.40 47.32,38.15 v1(47.54,37.93)
  Inner2 w0.305: v1(50.28,32.25) 68.31,32.25 69.49,31.07 69.49,9.78 69.05,9.34 v1(69.05,3.15)
  Bottom Layer w0.305: v1(50.28,32.25) 50.28,35.02 47.54,37.76 v1(47.54,37.93) ; R17.1 69.06,3.15 v1(69.05,3.15)
MOSI_ENC_Z_2: length 77.2
  Top Layer w0.305: v1(34.93,39.28) 34.93,40.24 34.51,40.65 33.36,40.65 ; U10.4 12.24,3.04 v1(12.26,3.02)
  Inner2 w0.305: v1(12.26,3.02) 12.26,6.65 13.33,7.72 38.23,7.72 39.5,9 39.5,22.97 v1(44.45,27.92)
  Bottom Layer w0.305: v1(44.45,27.92) 43.43,28.93 43.43,38.08 43.05,38.46 41.66,38.46 41.63,38.43 40.54,38.43 40.23,38.74 35.46,38.74 v1(34.93,39.28)
NFAULT_1: length 30.6
  Top Layer w0.305: U17.6 64.47,42.99 64.67,43.18 v1(65.23,43.18) ; v1(39.97,45.73) 40.36,45.33 U16.54
  Inner2 w0.305: v1(65.23,43.18) 63.09,43.18 61.59,44.68 56.39,44.68 56.01,44.3 53.97,44.3 53.47,44.81 40.88,44.81 v1(39.97,45.73)
NFAULT_2: length 24.3
  Top Layer w0.305: v1(40.67,42.46) 40.19,42.46 39.86,42.79 U16.55 ; v1(23.37,43.28) 22.8,43.28 22.11,42.59 U18.6
  Bottom Layer w0.305: v1(23.37,43.28) 25.37,45.28 27.51,45.28 28.56,44.24 32.51,44.24 34.57,42.17 40.38,42.17 v1(40.67,42.46)
NRST: length 69.8
  Top Layer w0.305: 33.36,39.15 31.94,39.15 31.75,38.97 v1(31.75,38.08)
  Top Layer w0.508: v1(74.47,17.62) 74.34,17.75 R2.2 ; 74.41,18.73 74.41,17.9
  Inner1 w0.305: v1(74.47,17.62) 74.47,18.33 74.17,18.63 74.17,25.94 v1(74.23,26.01) ; v1(31.99,31.23) 32.66,31.9 47.56,31.9 48.79,33.13 50.93,33.13 v1(52.2,34.39)
  Inner2 w0.305: v1(74.23,26.01) 74.29,26.07 74.29,30.04 70.3,34.03 52.56,34.03 v1(52.2,34.39)
  Bottom Layer w0.305: v1(31.75,38.08) 31.74,38.07 31.74,31.49 31.99,31.24 v1(31.99,31.23)
  Bottom Layer w0.508: v1(74.47,17.62) 74.47,16.78 SW1.1
NSCS_1: length 80.7
  Top Layer w0.305: U17.8 63.47,40.27 63.63,40.11 v1(64.64,40.11) ; v1(32,42.65) 31.88,42.52 31.88,41.89 32.11,41.65 34.91,41.65 35.81,40.75 v1(35.81,39.35)
  Inner1 w0.305: v1(49.88,29.7) 50.13,29.95 75.82,29.95 76.2,30.33 76.2,39.73 75.82,40.11 v1(64.64,40.11)
  Bottom Layer w0.305: v1(35.81,39.35) 40.51,39.35 40.89,38.97 43.31,38.97 43.88,38.39 43.88,29.63 44.58,28.93 49.12,28.93 v1(49.88,29.7)
NSCS_2: length 21.2
  Top Layer w0.305: 33.36,41.15 31.98,41.15 31.37,41.77 31.37,46.14 31.06,46.45 21.96,46.45 21.84,46.33 21.84,43.54 21.11,42.8 U18.8
OLED_DC: length 50
  Top Layer w0.305: U16.28 40.86,30.62 42.54,28.93 47.34,28.93 v1(47.96,29.56)
  Inner1 w0.305: v1(47.96,29.56) 48.76,29.56 49.71,30.52 75.24,30.52 v1(75.56,30.84)
  Bottom Layer w0.305: v1(75.56,30.84) 75.66,30.93 75.66,33.48 74.88,34.26 U12.9
OLED_SCL: length 46.6
  Top Layer w0.305: v1(47.25,29.93) 46.71,29.39 42.78,29.39 41.36,30.81 U16.29
  Inner1 w0.305: v1(74.93,31.47) 74.38,30.92 49.55,30.92 48.85,30.23 47.55,30.23 v1(47.25,29.93)
  Bottom Layer w0.305: v1(74.93,31.47) 74.87,31.53 74.87,32.99 74.31,33.56 U12.10
OLED_SDA: length 43.5
  Top Layer w0.305: v1(46.66,30.44) 46.04,29.82 42.93,29.82 41.86,30.89 U16.30
  Inner1 w0.305: v1(74.17,32.74) 74.17,31.91 73.71,31.45 49.26,31.45 48.59,30.78 47.01,30.78 v1(46.66,30.44)
  Bottom Layer w0.305: U12.11 74.06,32.86 v1(74.17,32.74)
OSC_IN: length 6.7
  Top Layer w0.305: 30.45,41.17 30.58,41.04 R5.2 30.66,40.15 33.36,40.15 ; 30.45,41.17 X1.2 ; 30.45,41.17 C16.1
OSC_OUT: length 6.8
  Top Layer w0.305: 27.93,37.04 28.5,37.61 30.54,37.61 ; 30.53,38.63 30.53,37.74 30.51,37.71 ; 33.36,39.65 31.57,39.65 30.68,38.76
RX: length 54.3
  Top Layer w0.305: 33.36,35.15 36.83,35.15 v1(37.72,36.05)
  Inner1 w0.305: v1(4.95,36.55) 14.12,36.55 15.44,35.23 20.54,35.23 21.12,35.81
  Inner2 w0.305: v1(21.18,35.8) 21.81,35.17 36.84,35.17 v1(37.72,36.05) ; v1(4.95,36.55) 8.84,36.55 9.14,36.86 v1(9.14,38.46)
  Bottom Layer w0.305: v1(4.95,36.55) 4.95,36.56 4.92,36.56 ; 10.72,46.68 9.74,46.68 9.04,45.97 9.04,38.57 v1(9.14,38.46)
SCK_ENC_B_1: length 69.4
  Top Layer w0.305: v1(42.1,40.3) 40.98,41.43 39.99,41.43 38.86,42.56 U16.57 ; U13.3 v1(68.05,3.15)
  Inner2 w0.305: v1(68.05,3.15) 68.05,9.1 69.09,10.14 69.09,30.46 67.96,31.58 49.99,31.58 49.45,32.12
  Bottom Layer w0.305: v1(42.1,40.3) 42.1,40.99 42.49,41.38 43.18,41.38 49.47,35.09 49.47,32.27
  vias: v1(49.48,32.26)
SCK_ENC_B_2: length 88.7
  Top Layer w0.305: v1(40.02,40.32) 39.59,40.32 37.86,42.05 U16.59 ; U10.3 v1(11.24,3.02)
  Inner2 w0.305: v1(11.24,3.02) 11.3,3.08 11.3,6.84 12.83,8.36 37.85,8.36 38.86,9.38 38.86,25.1 50.27,36.5 50.27,41.53 48.39,43.41 43.31,43.41 40.22,40.32 v1(40.02,40.32)
SERVO0: length 40.6
  Top Layer w0.305: 33.42,34.66 33.42,30.22 32.77,29.57 32.77,26.84 34.27,25.34 38.78,25.34 41.5,22.61 41.5,7.62 41.53,7.6 v1(41.53,3.16)
  Bottom Layer w0.305: v1(41.53,3.16) 42.15,3.16 42.54,2.76 42.54,1.38
SERVO1: length 38
  Top Layer w0.305: U16.17 35.36,31.28 33.27,29.19 33.27,26.91 34.39,25.79 39.08,25.79 41.95,22.92 41.95,4.34 42.69,3.6 42.69,2.55 42.42,2.28
SL_B_1: length 25.1
  Top Layer w0.305: v1(59.18,29.06) 58.47,29.77 U17.39
  Inner1 w0.305: v1(59.18,29.06) 56.51,29.06 v1(54.1,26.65)
  Inner2 w0.508: v1(51.7,14.01) 51.7,24.25 v1(54.1,26.65)
  vias: v1(51.74,12.92) v1(51.8,11.64) v1(52.01,12.32) v1(52.05,13.47) v1(52.13,11.05) v1(52.36,14.02) v1(52.43,12.92) v1(52.46,11.66) v1(52.64,12.34) v1(52.7,13.48) v1(52.83,11.01) v1(52.99,14.02) v1(53.08,12.9) v1(53.12,11.63) v1(53.34,13.48) v1(53.27,12.28) v1(53.54,11.04) v1(53.63,14.03) v1(53.7,12.89) v1(53.8,11.62) v1(53.95,13.49) v1(53.91,12.27)
SL_B_2: length 26
  Top Layer w0.305: U18.39 16.11,31.5 18.54,29.06 20,29.06 R36.2
  Inner2 w0.508: v1(20.83,28.3) 22.1,28.3 23.24,27.16 23.24,22.84 20.54,20.14 v1(20.54,14.03)
  vias: v1(20.57,12.94) v1(20.63,11.66) v1(20.84,12.34) v1(20.89,13.49) v1(20.97,11.07) v1(21.19,14.04) v1(21.26,12.94) v1(21.3,11.67) v1(21.53,13.5) v1(21.48,12.35) v1(21.66,11.03) v1(21.83,14.04) v1(21.92,12.92) v1(21.96,11.65) v1(22.11,12.29) v1(22.18,13.5) v1(22.38,11.05) v1(22.47,14.05) v1(22.54,12.9) v1(22.63,11.64) v1(22.79,13.51) v1(22.75,12.28)
SL_C_1: length 28.9
  Top Layer w0.305: U17.34 55.97,29.92 v1(55.25,29.19)
  Top Layer w0.508: R38.2 50.81,26.09 45.6,20.88 43.72,20.88 42.87,20.03 v1(42.87,14.01)
  Inner2 w0.305: v1(55.25,29.19) 51.31,29.19 50.8,28.68 v1(50.8,26.78)
  vias: v1(42.91,12.92) v1(42.96,11.64) v1(43.22,13.47) v1(43.17,12.32) v1(43.3,11.05) v1(43.53,14.02) v1(43.6,12.92) v1(43.63,11.66) v1(43.81,12.34) v1(43.87,13.48) v1(43.99,11.01) v1(44.16,14.02) v1(44.25,12.9) v1(44.29,11.63) v1(44.44,12.28) v1(44.51,13.48) v1(44.71,11.04) v1(44.8,14.03) v1(44.87,12.89) v1(44.97,11.62) v1(45.12,13.49) v1(45.08,12.27)
